# EasyEDA Pro project ZH_FLIGHT_H7B0.eprj, schematic Schematic1 (continued)
## Sheets (continued)
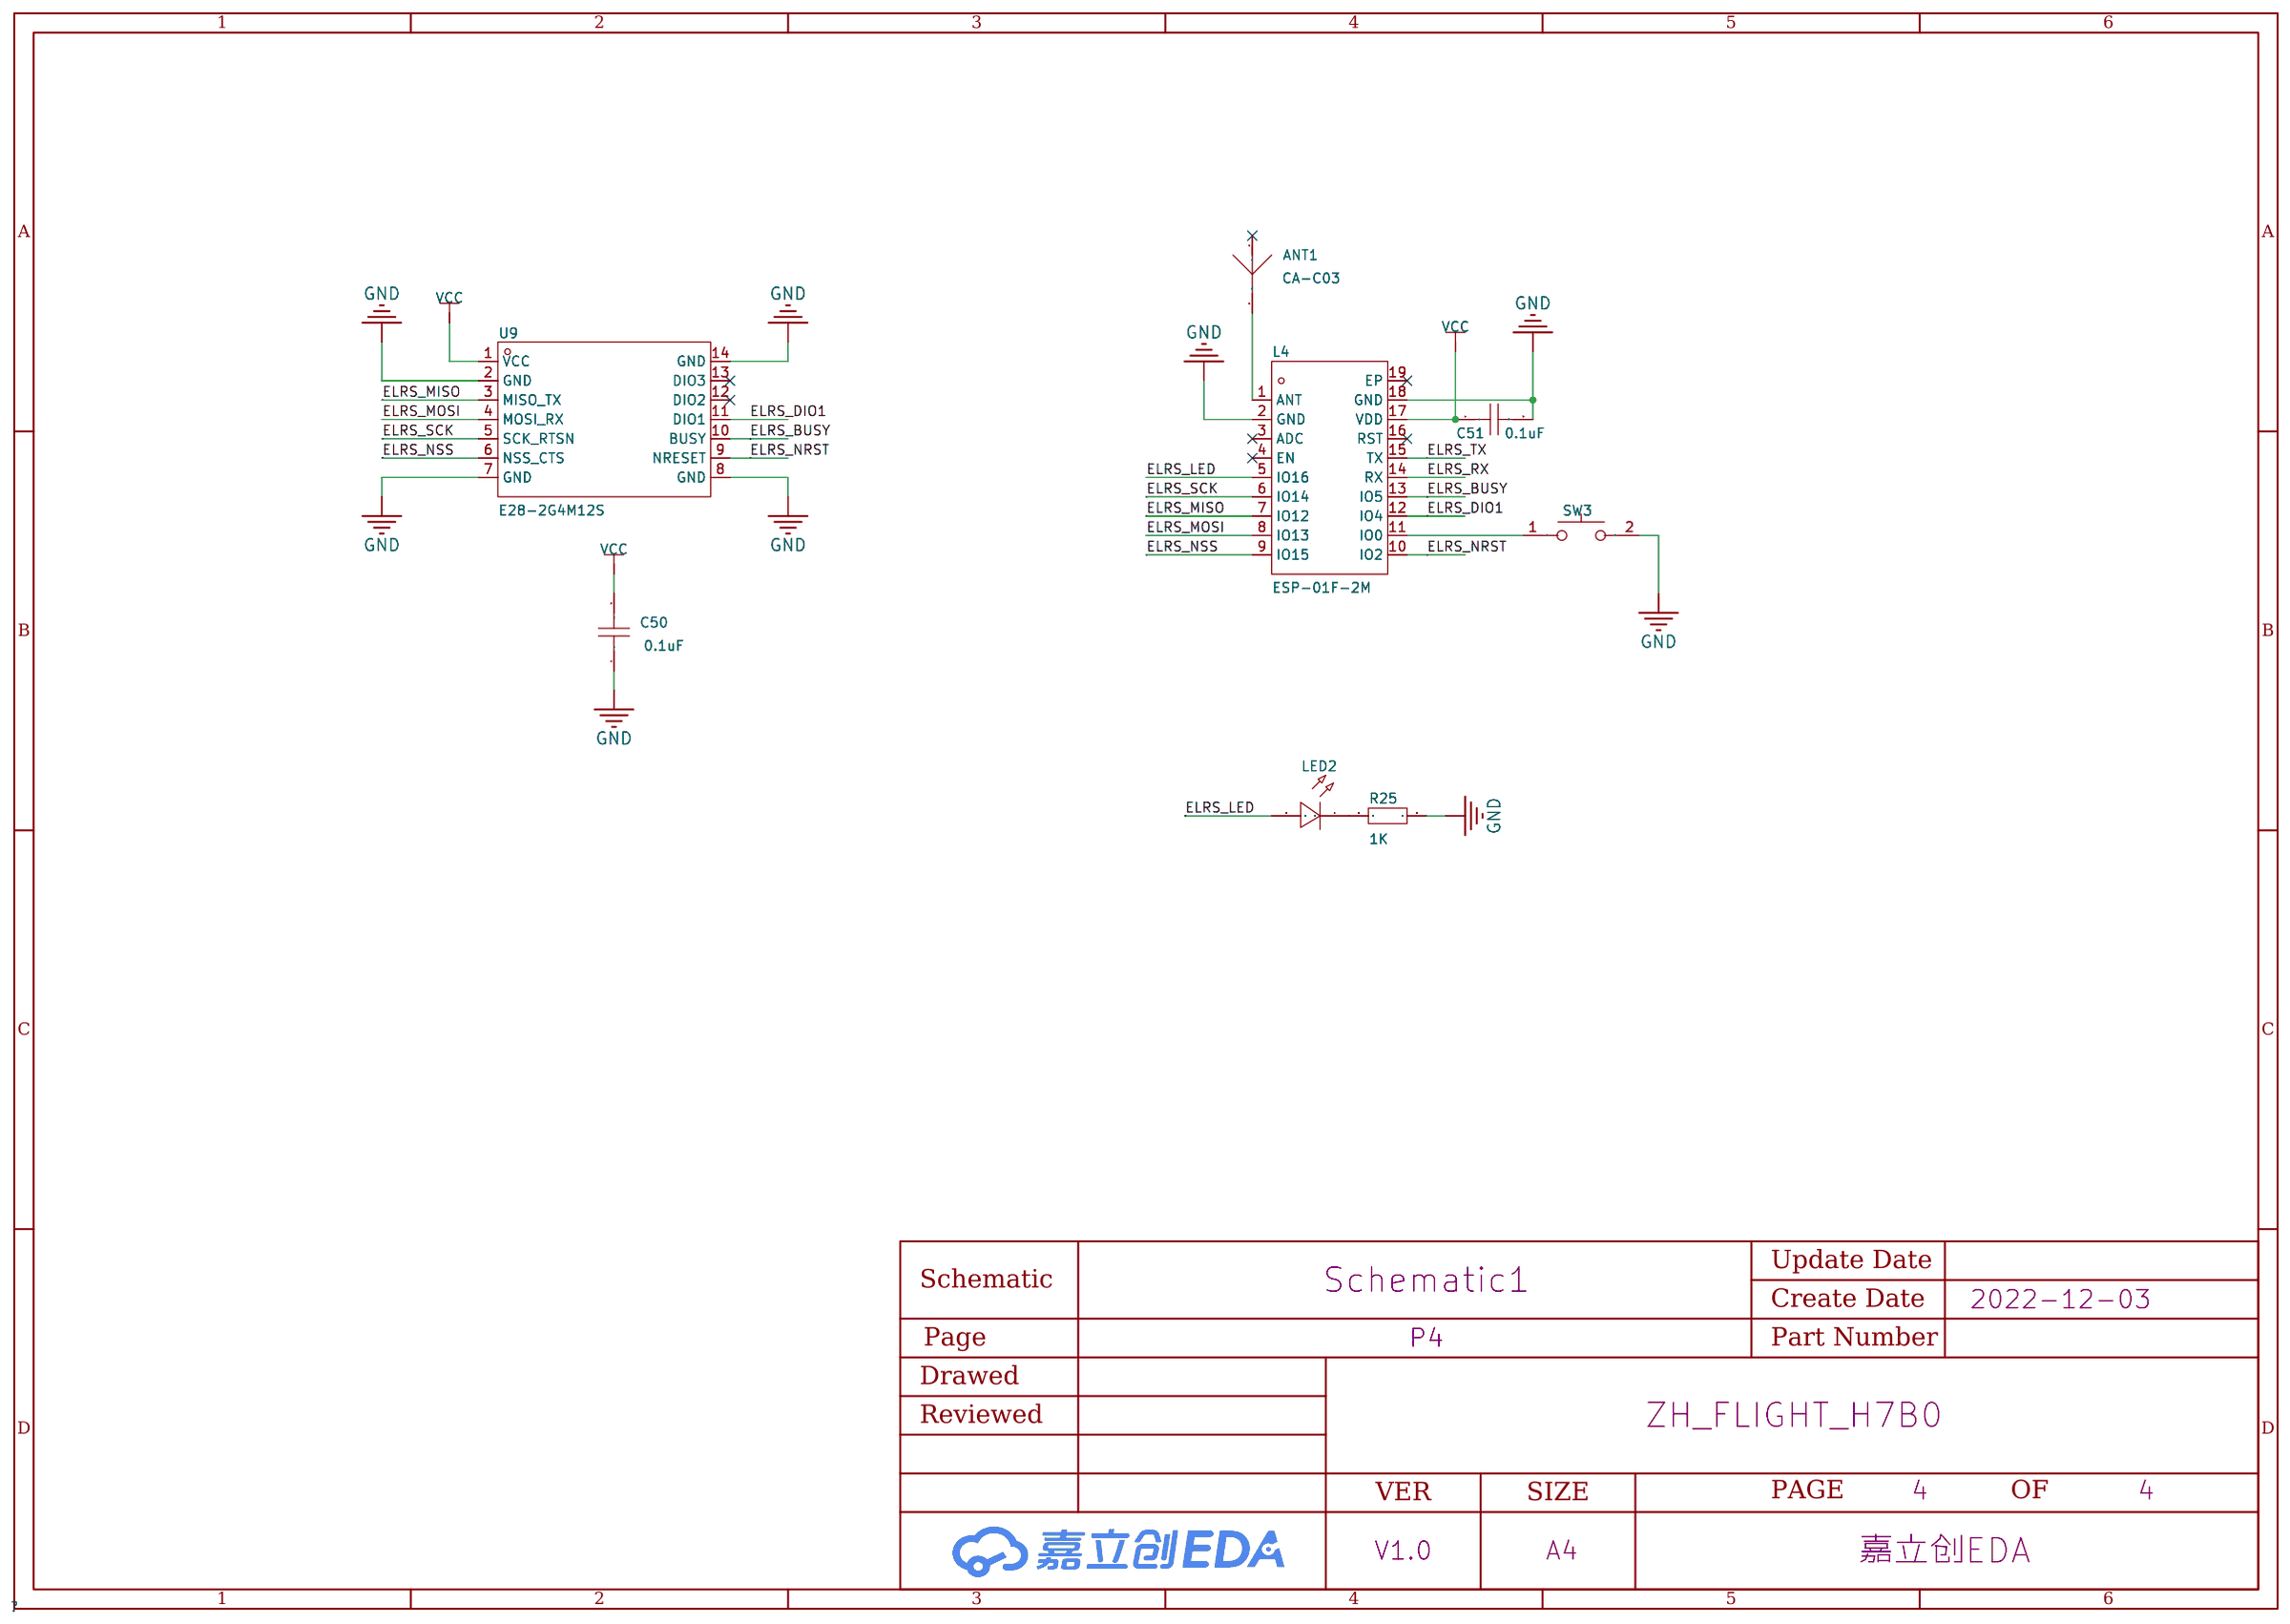
[diagram p3: P4]

## Parts
sheet P1
C1  2.2uF  [C0402]
C2  2.2uF  [C0402]
C3  22pF  [C0402]
C4  22pF  [C0402]
C5  6pF  [C0402]
C6  6pF  [C0402]
C7  0.1uF  [C0402]
C8  0.1uF  [C0402]
C9  0.1uF  [C0402]
C10  0.1uF  [C0402]
C11  0.1uF  [C0402]
C12  10uF  [C0402]
C13  10uF  [C0402]
C14  10uF  [C0402]
C15  10uF  [C0402]
C16  0.1uF  [C0402]
C17  0.1uF  [C0402]
C18  0.1uF  [C0402]
C19  0.1uF  [C0402]
C20  10uF  [C0402]
C21  22pF  [C0402]
C22  10uF  [C0402]
C23  0.1uF  [C0402]
CN1  GH1.25-2PWBPZ  [CONN-SMD_GH1.25-2PWBPZ]
CN2  GH1.25-2PWBPZ  [CONN-SMD_GH1.25-2PWBPZ]
CN3  GH1.25-2PWBPZ  [CONN-SMD_GH1.25-2PWBPZ]
CN4  GH1.25-2PWBPZ  [CONN-SMD_GH1.25-2PWBPZ]
CN5  GH1.25-2PWBPZ  [CONN-SMD_GH1.25-2PWBPZ]
CN6  GH1.25-2PWBPZ  [CONN-SMD_GH1.25-2PWBPZ]
CN7  GH1.25-2PWBPZ  [CONN-SMD_GH1.25-2PWBPZ]
CN8  HDGC2001WR-S-2P  [CONN-SMD_2P-P2.00_HDGC_HDGC2001WR-S-2P]
CN9  HDGC2001WR-S-2P  [CONN-SMD_2P-P2.00_HDGC_HDGC2001WR-S-2P]
D1  BAT54C-KL3  [sot-23-3_l2.9-w1.3-p1.90-ls2.4-br]
D2  1N4148WS  [sod-323_l1.8-w1.3-ls2.5-rd]
E1  CESD5V0D3 ZA  [sod-323_l1.8-w1.3-ls2.5-rd]
E2  CESD3V3D3 YU  [sod-323_l1.8-w1.3-ls2.5-rd]
L1  SCBG160808U501T  [l0603]
L2  2.2uH  [ind-smd_l2.5-w2.0]
LED1  -  [LED0603-RD_BLUE]
LED3  -  [LED0603-RD_BLUE]
LED4  -  [LED0603-RD]
OS1  25MHz  [osc-smd_4p-l3.2-w2.5-bl]
OS2  32.768kHz  [osc-smd_2p-l1.6-w1.0]
Q1  SS8050  [sot-23-3_l2.9-w1.3-p1.90-ls2.4-br]
Q2  SS8050  [sot-23-3_l2.9-w1.3-p1.90-ls2.4-br]
R1  0R  [R0402]
R2  10K  [R0402]
R3  10K  [R0402]
R4  10K  [R0402]
R5  1K  [R0402]
R6  10K  [R0402]
R7  680K  [R0402]
R8  150K  [R0402]
R9  5.1K  [R0402]
R10  5.1K  [R0402]
R12  10K  [R0402]
R13  10K  [R0402]
R14  10K  [R0402]
R15  10K  [R0402]
R16  3K  [R0402]
R28  1K  [R0402]
SW1  K2-1827SQ-C3DW-06  [sw-smd_l3.0-w2.0-ls3.5]
SW2  K2-1827SQ-C3DW-06  [sw-smd_l3.0-w2.0-ls3.5]
U1  STM32H7B0VBT6  [lqfp-100_l14.0-w14.0-p0.50-ls16.0-bl]
U2  XT3410AFMR-G  [sot-23-5_l3.0-w1.7-p0.95-ls2.8-bl]
U8  W25Q64JVXGIQ  [XSON-8_L4.0-W4.0-P0.80-TL-EP]
U10  GH1.25-4PLTPZ  [CONN-SMD_4P-P1.25_GH1.25-4P]
U11  GH1.25-4PLTPZ  [CONN-SMD_4P-P1.25_GH1.25-4P]
U12  GH1.25-4PLTPZ  [CONN-SMD_4P-P1.25_GH1.25-4P]
U13  GH1.25-4PLTPZ  [CONN-SMD_4P-P1.25_GH1.25-4P]
USB1  TYPEC-304A-ACP16W  [usb-c_smd-type-c-31-m-12]
sheet P2
C24  0.1uF  [C0402]
C25  2.2uF  [C0402]
C26  0.47uF  [C0402]
C27  10nF  [C0402]
C28  0.1uF  [C0402]
C29  0.22uF  [C0402]
C30  4.7uF  [C0402]
C31  0.1uF  [C0402]
C52  10nF  [C0402]
C53  0.1uF  [C0402]
C54  2.2uF  [C0402]
R11  ICM-20689  [QFN-24_L4.0-W4.0-P0.50-TL-EP2.6]
R26  ICM-42688-P  [LGA-14_L3.0-W2.5-P0.50-TL]
R27  10K  [R0402]
U4  MS5611-01BA03  [SENSORS-SMD_MS5611-01BA03]
U5  QMC5883L  [LGA-16_L3.0-W3.0-P0.50-BL_SQ]
sheet P3
C41  N/A  [C1206]
C42  22uF  [C1206]
C43  0.1uF  [C0402]
C44  0.1uF  [C0402]
C45  0.1uF  [C0402]
C46  33pF  [C0402]
C47  22uF  [C0805]
C48  22uF  [C0805]
C49  N/A  [C0805]
L3  4.7uH  [IND-SMD_L7.3-W6.6]
R19  100K  [R0402]
R20  10R  [R0402]
R21  0R  [R0402]
R22  40.2K  [R0402]
R23  5.49K  [R0402]
U6  MP2225GJ  [TSOT-23-8_L2.9-W1.6-P0.65-LS2.8-BR]
U7  SMAJ12A  [SMA_L4.3-W2.6-LS5.2-RD]
sheet P4
ANT1  CA-C03  [ANT-SMD_CA-C03]
C50  0.1uF  [C0402]
C51  0.1uF  [C0402]
L4  ESP-01F-2M  [wifim-smd_esp-01f-2m]
LED2  -  [LED0603-RD]
R25  1K  [R0402]
SW3  K2-1827SQ-C3DW-06  [sw-smd_l3.0-w2.0-ls3.5]
U9  E28-2G4M12S  [WIRELM-SMD_E28-2G4M12S]

## Library data of the parts
C1-C31 C43-C46 C50-C54 = CAP_0402: Supplier Footprint: 0402
CN1-CN7 = GH1.25-2PWBPZ: LCSC Part Name: GH1.25-2P卧贴编带; Supplier Part: C2829251; Manufacturer: BOOMELE(博穆精密); JLCPCB Part Class: 扩展库; Datasheet: https://atta.szlcsc.com/upload/public/pdf/source/20211125/08A09A4909F58AF780B71FE423A00F7E.pdf; Supplier: LCSC
CN8 CN9 = HDGC2001WR-S-2P: 参考系列:PH;间距:2mm;插针结构:1x2P;排数:1;每排PIN数:2;行距:-;公母:公型插针;安装方式:卧贴;额定电流:5A;工作温度范围:-25℃~+70℃;; LCSC Part Name: PH2.0针座卧贴 2P; Supplier Part: C2936224; Manufacturer: HDGC(华德共创); Supplier Footprint: SMD,P=2mm; JLCPCB Part Class: 扩展库; Datasheet: https://atta.szlcsc.com/upload/public/pdf/source/20211224/97C496F606ECD8881F21462B7EF9EC10.pdf; Supplier: LCSC; Reference Series: PH; Pitch: 2mm; Pins Structure: 1x2P; Number of Rows: 1; Number of PINs Per Row: 2; Gender: 公型插针; Mounting Style: 卧贴; Current Rating (Max): 5A; Operating Temperature Range: -25℃~+70℃
D1 = BAT54C-KL3: 二极管配置:1对共阴极;直流反向耐压(Vr):30V;平均整流电流(Io):200mA;正向压降(Vf):1V@100mA;反向电流(Ir):2A@25V;; LCSC Part Name: 30V 200mA 1V@100mA; Supplier Part: C779698; Manufacturer: ZRE(治润); Supplier Footprint: SOT-23; Datasheet: https://atta.szlcsc.com/upload/public/pdf/source/20201013/C779697_FADF87324DB075BDE4E981624DEB8F45.pdf; Supplier: LCSC; Diode Configuration: 1对共阴极; Reverse Voltage (Vr): 30V; Average Rectified Current (Io): 200mA; Forward Voltage (Vf@If): 1V@100mA; Reverse Leakage Current (Ir): 2A@25V
D2 = 1N4148WS_C2128: 二极管配置:独立式;功率:200mW;直流反向耐压(Vr):100V;平均整流电流(Io):150mA;正向压降(Vf):1.25V@150mA;反向电流(Ir):1A@75V;反向恢复时间(trr):4ns;工作温度:+150@(Tj);; LCSC Part Name: 100V 150mA 4ns T4; Supplier Part: C2128; Manufacturer: CJ（江苏长电/长晶）; Supplier Footprint: SOD-323; Datasheet: https://atta.szlcsc.com/upload/public/pdf/source/20140809/1457707208178.pdf; Supplier: LCSC; Diode Configuration: 独立式; Power Dissipation: 200mW; Reverse Voltage (Vr): 100V; Average Rectified Current (Io): 150mA; Forward Voltage (Vf@If): 1.25V@150mA; Reverse Leakage Current: 1A@75V; Reverse Recovery Time (trr): 4ns; Operating Temperature: +150@(Tj)
E1 = CESD5V0D3 ZA: 极性:Unidirectional;反向关断电压（典型值）:5V;击穿电压（最小值）:6.2V;箝位电压:15.5V;峰值脉冲电流（10/1000us）:15A;; LCSC Part Name: CESD5V0D3  ZA; Supplier Part: C22643; Manufacturer: CJ（江苏长电/长晶）; Supplier Footprint: SOD-323; Datasheet: https://atta.szlcsc.com/upload/public/pdf/source/20140301/1457707004115.pdf; Supplier: LCSC; Polarity: Unidirectional; Voltage - Reverse Standoff (Typ): 5V; Voltage - Breakdown (Min): 6.2V; Voltage - Clamping (Max) @ Ipp: 15.5V; Current - Peak Pulse (10/1000μs): 15A
E2 = CESD3V3D3 YU: 极性:Unidirectional;反向关断电压（典型值）:3.3V;击穿电压（最小值）:5V;箝位电压:13V;峰值脉冲电流（10/1000us）:16A;; Supplier Part: C38388; Manufacturer: CJ（江苏长电/长晶）; Supplier Footprint: SOD-323; Datasheet: https://atta.szlcsc.com/upload/public/pdf/source/20150915/1457707371129.pdf; Supplier: LCSC; Polarity: Unidirectional; Voltage - Reverse Standoff (Typ): 3.3V; Voltage - Breakdown (Min): 5V; Voltage - Clamping (Max) @ Ipp: 13V; Current - Peak Pulse (10/1000μs): 16A
L1 = SCBG160808U501T: 叠层片式通用磁珠0603 500±25% DCR0.6 额定电流150MA; LCSC Part Name: 500 ±25% @100MHz 150MA; Supplier Part: C480859; Manufacturer: Yanchuang(研创); Supplier Footprint: 0603; Datasheet: https://atta.szlcsc.comnull; Supplier: LCSC
L2 = WIP252010P-2R2ML: 电感值:2.2uH;精度:±20%;额定电流:2.3A;直流电阻(DCR):99m;; LCSC Part Name: 2.2uH ±20% 2.3A 99m; Supplier Part: C315713; Manufacturer: INPAQ(台湾佳邦); Supplier Footprint: SMD; Datasheet: https://atta.szlcsc.com/upload/public/pdf/source/20181022/C315713_B673B90C1AD4F1577F17AD7F983BB877.pdf; Supplier: LCSC; Tolerance: ±20%; Rated Current: 2.3A; DC Resistance (DCR): 99m
LED1 = LED_0603-R: 发光颜色:红灯;二极管配置:-;透镜颜色:无色透明;主波长:617.5nm;峰值波长:632nm;色温:-;光通量(25℃时):-;测试电流:5mA;正向电压(VF):2.2V;发光强度:28.5mcd;功率:60mW;发光角度:120°;安装方式:-;工作温度:-40℃~+85℃;; Supplier Footprint: 0603; Supplier Part: C72044
LED3 = LED_0603-B: 照明颜色:蓝色;主波长/色坐标:465~475nm;; Supplier Footprint: 0603; Supplier Part: C72041
LED2 LED4 = LED_0603-G: 照明颜色:翠绿;色温 - CCT（K）:-;主波长/色坐标:520~535nm;; Supplier Footprint: 0603; Supplier Part: C72043
OS1 = X322525MOB4SI: 晶振类型:贴片无源晶振;频率:25MHz;频率公差:±10ppm;频率稳定度:±30ppm;负载电容:12pF;工作温度:-40~+85;; LCSC Part Name: 25MHz ±10ppm 12pF; Supplier Part: C9006; Manufacturer: YXC(扬兴晶振); Supplier Footprint: SMD3225-4P; Datasheet: https://atta.szlcsc.com/upload/public/pdf/source/20210329/C112971_1F611BDC486E193C1706F6D8EB5AA189.pdf; Supplier: LCSC; Crystal Type: 贴片无源晶振; Frequency Tolerance: ±10ppm; Frequency Stability: ±30ppm; Load Capacitance: 12pF; Operating Temperature: -40~+85
OS2 = X1A0001210005: 晶振类型:贴片无源晶振;频率:32.768kHz;频率公差:±20ppm;负载电容:12.5pF;工作温度:-40~+85;; LCSC Part Name: 32.768kHz ±20ppm 12.5pF; Supplier Part: C165064; Manufacturer: EPSON(爱普生); Supplier Footprint: SMD1610-2P; Datasheet: https://atta.szlcsc.com/upload/public/pdf/source/20181223/C165064_89E145695707DA426F5051ABEBF35627.pdf; Supplier: LCSC; Crystal Type: 贴片无源晶振; Frequency Tolerance: ±20ppm; Load Capacitance: 12.5pF; Operating Temperature: -40~+85
Q1 Q2 = SS8050_C2150: 晶体管类型:NPN;集射极击穿电压(Vceo):25V;集电极电流(Ic):1.5A;功率(Pd):300mW;集电极-发射极饱和电压(VCE(sat)@Ic,Ib):500mV@800mA,80mA;直流电流增益(hFE@Ic,Vce):200@100mA,1V;特征频率(fT):100MHz;工作温度:+150@(Tj);; LCSC Part Name: SS8050 Y1 200-350 Y1 200-350; Supplier Part: C2150; Manufacturer: CJ(江苏长电/长晶); Supplier Footprint: SOT-23(SOT-23-3); Datasheet: https://atta.szlcsc.com/upload/public/pdf/source/20140809/1457707209319.pdf; Supplier: LCSC; Transistor Type: NPN; Collector-Emitter Breakdown Voltage (Vceo): 25V; Collector Current (Ic): 1.5A; Power Dissipation (Pd): 300mW; Collector-Emitter Saturation Voltage (VCE(sat)@Ic,Ib): 500mV@800mA,80mA; DC Current Gain (hFE@Ic,Vce): 200@100mA,1V; Transition Frequency (fT): 100MHz; Operating Temperature: +150@(Tj)
R1-R10 R12-R16 R19-R23 R25 R27 R28 = Res_0402: Supplier Footprint: 0402
SW1-SW3 = K2-1827SQ-C3DW-06: 触点电流:50mA;额定电压(DC):12V;绝缘电阻:100M;电路结构:单刀单掷;安装方式:立贴;按钮形状:圆形按钮;带灯:-;作用力:180gf@±30gf;机械寿命:100000;工作温度:-25~+85;开关长度:3mm;开关宽度:2mm;开关高度:0.65mm;; LCSC Part Name: 薄膜开关 3.0mm*2.0mm*0.65mm 180G; Supplier Part: C128936; Manufacturer: 韩国韩荣; Supplier Footprint: SMD; Datasheet: https://atta.szlcsc.com/upload/public/pdf/source/20210810/197683357D425767B80DA50394975E40.pdf; Supplier: LCSC; Contact Current: 50mA; Voltage Rating (DC): 12V; Insulation Resistance: 100M; Circuit: 单刀单掷; Mounting Style: 立贴; Actuator Style: 圆形按钮; Operating Force: 180gf@±30gf; Mechanical Life: 100000; Operating Temperature: -25~+85; Switch Length: 3mm; Switch Width: 2mm; Switch Height: 0.65mm
U1 = STM32H7B0VBT6: CPU位数:-;ROM类型:-;CPU内核:-;主频（MAX):-;工作电压:-;; Supplier Part: C730227; Manufacturer: ST(意法半导体); Supplier Footprint: LQFP-100; Datasheet: https://atta.szlcsc.com/upload/public/pdf/source/20200902/C730225_664883C886B4E760FDC927233147DBDC.pdf; Supplier: LCSC
U2 = XT3410AFMR-G: 功能类型:降压型;同步整流:-;输出通道数:-;拓扑结构:-;输入电压:-;输出电流(最大值):-;开关频率:-;; LCSC Part Name: 降压型; Supplier Part: C190829; Manufacturer: natlinear(南麟); Supplier Footprint: SOT-23-5L; Datasheet: https://atta.szlcsc.com/upload/public/pdf/source/20180417/C190829_F6912E3BE098993FBE8C3B1025739217.pdf; Supplier: LCSC; Function: 降压型
U8 = W25Q64JVXGIQ: Supplier Part: C2940195; Manufacturer: WINBOND(华邦); Supplier Footprint: XSON-8(4x4); JLCPCB Part Class: 扩展库; Datasheet: https://atta.szlcsc.com/upload/public/pdf/source/20220111/96C134BA110DAC08742B3CB6C4519B4C.pdf; Supplier: LCSC
U10-U13 = GH1.25-4PLTPZ: LCSC Part Name: GH1.25-4P立贴编带加盖; Supplier Part: C2829262; Manufacturer: BOOMELE(博穆精密); JLCPCB Part Class: 扩展库; Datasheet: https://atta.szlcsc.com/upload/public/pdf/source/20211125/08A09A4909F58AF780B71FE423A00F7E.pdf; Supplier: LCSC
USB1 = TYPEC-304A-ACP16W: 连接器类型:Type-C;标准:USB 3.1;公母:母座;触点数量:16;端口数量:1;安装方式:卧贴;额定电流 - 电源:5A;工作温度范围:-45~+85;焊接温度(最大值):260;; LCSC Part Name: Type-C 母座 卧贴; Supplier Part: C2909607; Manufacturer: XUNPU(讯普); Supplier Footprint: SMD,8.94x7.35x3.26mm; Datasheet: https://atta.szlcsc.com/upload/public/pdf/source/20211029/5A76838C591B377E5BF09726BF37DE5A.pdf; Supplier: LCSC; Connector Type: Type-C; Standard: USB 3.1; Gender: 母座; Number of Contacts: 16; Number of Ports: 1; Mounting Style: 卧贴; Current Rating - Power (Max): 5A; Operating Temperature Range: -45~+85; Welding Temperature (Max): 260
R11 = ICM-20689: Supplier Part: C2649494; Manufacturer: TDK InvenSense(应美盛); Supplier Footprint: QFN-24(4x4); JLCPCB Part Class: 扩展库; Datasheet: https://atta.szlcsc.com/upload/public/pdf/source/20210612/84049ED953CCDAE32DEC78FBBA9615C4.pdf; Supplier: LCSC
R26 = ICM-42688-P: LCSC Part Name: ICM 42688 P; Supplier Part: C1850418; Manufacturer: TDK InvenSense(应美盛); JLCPCB Part Class: 扩展库; Datasheet: https://atta.szlcsc.com/upload/public/pdf/source/20210703/CF24204867ACE5B754A2B035F23E5931.pdf; Supplier: LCSC
U4 = MS5611-01BA03: 类型:-;波长:-;近距离探测:-;输出类型:-;; Supplier Part: C37148; Manufacturer: MEAS; Supplier Footprint: QFN-8(5x3); JLCPCB Part Class: 扩展库; Datasheet: https://atta.szlcsc.com/upload/public/pdf/source/20140924/1457707242210.pdf; Supplier: LCSC
U5 = QMC5883L: LCSC Part Name: 三轴磁传感器; Supplier Part: C976032; Manufacturer: QST(上海矽睿); Supplier Footprint: LGA-16(3x3x0.9mm); JLCPCB Part Class: 扩展库; Datasheet: https://atta.szlcsc.com/upload/public/pdf/source/20201217/C976032_5B9A2F3901E175046CBA037B1F18A1F2.pdf; Supplier: LCSC
C41 C42 = CAP_1206: Supplier Footprint: 1206
C47-C49 = CAP_0805: Supplier Footprint: 0805
L3 = MCS0630-4R7MPY1: 电感值:4.7uH;精度:±20%;额定电流:5.5A;饱和电流(Isat):7A;直流电阻(DCR):37mΩ;; LCSC Part Name: 4.7uH ±20% 5.5A 37mΩ; Supplier Part: C2937097; Manufacturer: PSA(信昌电陶); Supplier Footprint: 0630; JLCPCB Part Class: 扩展库; Datasheet: https://atta.szlcsc.com/upload/public/pdf/source/20220121/EA6E6E6F70ED7BAE67EC293805EAAACB.pdf; Supplier: LCSC; Tolerance: ±20%; Rated Current: 5.5A; Saturation Current (Isat): 7A; DC Resistance (DCR): 37mΩ
U6 = MP2225GJ: link: https://www.monolithicpower.com/en/documentview/productdocument/index/version/2/document_type/Datasheet/lang/en/sku/MP2225GJ-Z/document_id/922/
U7 = SMAJ12A_C2991109: 极性:单向;反向截止电压(Vrwm):12V;击穿电压(最小值):13.3V;击穿电压(最大值):15.3V;反向漏电流(Ir):5uA;峰值脉冲电流(Ipp)@10/1000s:20.1A;最大钳位电压:19.9V;; LCSC Part Name: 单向 Vrwm:12V; Supplier Part: C2991109; Manufacturer: SUNMATE(森美特); Supplier Footprint: SMA/DO-214AC; JLCPCB Part Class: 扩展库; Datasheet: https://atta.szlcsc.com/upload/public/pdf/source/20220427/B75BE6AB9B7C97585C60DE27DE4A19A3.pdf; Supplier: LCSC; Polarity: 单向; Reverse Stand-Off Voltage (Vrwm): 12V; Breakdown Voltage (Min): 13.3V; Breakdown Voltage (Max): 15.3V; Reverse Leakage Current (Ir): 5uA; Peak Pulse Current (Ipp)@10/1000μs: 20.1A; Maximum Clamping Voltage: 19.9V
ANT1 = CA-C03: Supplier Part: C2838842; Supplier Footprint: 5520; JLCPCB Part Class: 扩展库; Datasheet: 2021-06-05/34112A/eaa7f794ae26492fadde70fdd3fe967f/CA-C03应用手册.pdf; Supplier: LCSC
L4 = ESP-01F-2M: LCSC Part Name: WIFI模块 ESP-01F-2M版; Supplier Part: C2764054; Manufacturer: Ai-Thinker(安信可); Datasheet: https://atta.szlcsc.com/upload/public/pdf/source/20210401/C2764054_7A91A27C6594F8A1968F9CAA7474E658.pdf; Supplier: LCSC
U9 = E28-2G4M12S: SX1280无线模块(SX1278的2.4GHz版)无线测距/定位LoRa扩频2.4G; Supplier Part: C411310; Manufacturer: EBYTE(亿佰特); Supplier Footprint: SMD,14.0x25.0mm; JLCPCB Part Class: 扩展库; Datasheet: https://atta.szlcsc.com/upload/public/pdf/source/20190812/C411310_35CC255654AEA531A1D9F26CF905C5EF.pdf; Supplier: LCSC

## Nets
+5V: C20.2 C46.2 C47.2 C48.2 C49.2 CN9.1 E1.1 L3.2 R22.2 U2.1(CE) U2.4(VIN) USB1.A4(VBUS) USB1.A9(VBUS) USB1.B4(VBUS) USB1.B9(VBUS)
+12V: C41.2 C42.2 C43.2 CN8.1 R19.1 U6.2(IN) U7.2
GND: C1.2 C2.1 C3.1 C4.1 C5.1 C6.1 C7.1 C8.1 C9.1 C10.1 C11.1 C12.1 C13.1 C14.1 C15.1 C16.1 C17.1 C18.1 C19.1 C20.1 C22.1 C23.1 C24.1 C25.1 C26.1 C27.1 C28.1 C30.2 C31.1 C41.1 C42.1 C43.1 C44.1 C47.1 C48.1 C49.1 C50.1 C51.2 C52.1 C53.1 C54.1 CN1.3 CN1.4 CN2.3 CN2.4 CN3.3 CN3.4 CN4.3 CN4.4 CN5.3 CN5.4 CN6.3 CN6.4 CN7.3 CN7.4 CN8.2 CN8.3 CN8.4 CN9.2 CN9.3 CN9.4 E1.2 E2.2 L4.2(GND) L4.18(GND) LED1.1(C) LED4.1(C) Q1.2(E) R3.1 R6.1 R8.1 R9.2 R10.1 R11.11(FSYNC) R11.18(GND) R23.1 R25.2 R26.6(GND) R26.11(RESV) R27.2 SW2.2 SW3.2 U1.10(VSS) U1.19(VSSA) U1.26(VSS) U1.49(VSS) U1.74(VSS) U1.99(VSS) U2.2(GND) U4.3(GND) U4.4(CSB) U4.5(CSB) U5.9(GND) U5.11(GND) U6.1(AGND) U6.4(GND) U7.1 U8.4(GND) U9.2(GND) U9.7(GND) U9.8(GND) U9.14(GND) U10.5 U10.6 U11.5 U11.6 U12.5 U12.6 U13.5 U13.6 USB1.0(EH) USB1.1(EH) USB1.2(EH) USB1.3(EH) USB1.A1(GND) USB1.A12(GND) USB1.B1(GND) USB1.B12(GND)
VBAT: C16.2 D1.3(K) U1.6(VBAT)
VBAT_EXT: D1.2(A)
VCC: C7.2 C8.2 C9.2 C10.2 C11.2 C21.2 C22.2 C23.2 C24.2 C25.2 C27.2 C28.2 C31.2 C50.2 C51.1 C52.2 C53.2 C54.2 D1.1(A) E2.1 L1.1 L2.2 L4.17(VDD) R4.2 R5.2 R7.2 R11.8(VDDIO) R11.13(VDD) R12.1 R13.1 R14.1 R15.1 R16.1 R26.5(VDDIO) R26.8(VDD) R28.1 SW1.1 U1.11(VDD) U1.27(VDD) U1.50(VDD) U1.75(VDD) U1.100(VDD) U4.1(VDD) U4.2(PS) U5.2(VDD) U5.4(S1) U5.13(VDDIO) U8.8(VCC) U9.1(VCC)
VDDA: C12.2 C13.2 L1.2 R1.2 U1.21(VDDA)
25M_IN: C3.2 OS1.3(OSC2) U1.12(PH0-OSC_IN)
25M_OUT: C4.2 OS1.1(OSC1) U1.13(PH1-OSC_OUT)
32K_IN: C5.2 OS2.2(OSC2) U1.8(PC14-OSC32_ON)
32K_OUT: C6.2 OS2.1(OSC1) U1.9(PC15-OSC32_OUT)
ADC1_10: U1.15(PC0) U13.3
ADC1_11: U1.16(PC1) U13.4
ADC2_8: U1.33(PC5) U13.1
ADC2_9: U1.34(PB0) U13.2
BOOT0: LED1.2(A) Q2.2(E) R6.2 U1.94(BOOT0)
ELRS_BUSY: L4.13(IO5) U9.10(BUSY)
ELRS_DIO1: L4.12(IO4) U9.11(DIO1)
ELRS_LED: L4.5(IO16) LED2.2(A)
ELRS_MISO: L4.7(IO12) U9.3(MISO_TX)
ELRS_MOSI: L4.8(IO13) U9.4(MOSI_RX)
ELRS_NRST: L4.10(IO2) U9.9(NRESET)
ELRS_NSS: L4.9(IO15) U9.6(NSS_CTS)
ELRS_RX: L4.14(RX) U1.86(PD5)
ELRS_SCK: L4.6(IO14) U9.5(SCK_RTSN)
ELRS_TX: L4.15(TX) U1.87(PD6)
EXTI3: CN7.1 U1.89(PB3)
EXTI7: CN7.2 U1.88(PD7)
IIC1_EXIT: U1.97(PE0) U5.15(DRDY)
IIC1_SCL: R14.2 U1.95(PB8) U4.8(SCLK) U5.1(SCL)
IIC1_SDA: R15.2 U1.96(PB9) U4.7(SDI/SDA) U5.16(SDA)
IIC2_SCL: CN5.2 R12.2 U1.46(PB10)
IIC2_SDA: CN5.1 R13.2 U1.47(PB11)
IMU1_CLK: R11.23(SCL/SCLK) U1.29(PA5)
IMU1_CS: R11.22(nCS) U1.28(PA4)
IMU1_EXIT: R11.12(INT) U1.32(PC4)
IMU1_MISO: R11.9(AD0/SDO) U1.30(PA6)
IMU1_MOSI: R11.24(SDA/SDI) U1.31(PA7)
IMU2_CLK: R26.13(AP_SCL/AP_SCLK) U1.78(PC10)
IMU2_CS: R26.12(AP_CS) U1.81(PD0)
IMU2_EXIT: R26.4(INT1/INT) U1.77(PA15)
IMU2_MISO: R26.1(AP_SDO/AP_AD0) U1.79(PC11)
IMU2_MOSI: R26.14(AP_SDA/AP_SDIO/AP_SDI) U1.80(PC12)
LED: LED3.1(C) U1.18(PC3_C)
PWM1: U1.63(PC6) U10.1
PWM2: U1.64(PC7) U10.2
PWM3: U1.65(PC8) U10.3
PWM4: U1.66(PC9) U10.4
PWM5: U1.22(PA0) U11.1
PWM6: U1.23(PA1) U11.2
PWM7: U1.24(PA2) U11.3
PWM8: U1.25(PA3) U11.4
PWM9: U1.62(PD15) U12.1
PWM10: U1.61(PD14) U12.2
PWM11: U1.91(PB5) U12.3
PWM12: U1.90(PB4) U12.4
QSPI_BK1_IO0: U1.58(PD11) U8.5(DI(IO0))
QSPI_BK1_IO1: U1.59(PD12) U8.2(DO(IO1))
QSPI_BK1_IO2: U1.1(PE2) U8.3(IO2)
QSPI_BK1_IO3: U1.60(PD13) U8.7(IO3)
QSPI_BK1_NCS: U1.92(PB6) U8.1(CS#)
QSPI_CLK: U1.36(PB2) U8.6(CLK)
RST: C18.2 Q1.3(C) R4.1 SW2.1 U1.14(NRST)
SW_CLK: CN6.2 U1.76(PA14)
SW_DIO: CN6.1 U1.72(PA13)
UART1_RX: CN1.1 U1.54(PB15)
UART1_TX: CN1.2 U1.53(PB14)
UART3_RX: CN2.1 U1.56(PD9)
UART3_TX: CN2.2 U1.55(PD8)
UART5_RX: CN3.2 U1.51(PB12)
UART5_TX: CN3.1 U1.52(PB13)
UART7_RX: CN4.2 U1.37(PE7)
UART7_TX: CN4.1 U1.38(PE8)
USB_D+: U1.71(PA12) USB1.A6(DP1) USB1.B6(DP2)
USB_D-: U1.70(PA11) USB1.A7(DN1) USB1.B7(DN2)
VREF: C14.2 C15.2 R1.1 U1.20(VREF+)
$1N1678: C1.1 U1.73(VCAP)
$1N1681: C2.2 U1.48(VCAP)
$1N8061: C17.2 Q1.1(B) R2.2 R3.2
$1N8406: C19.2 D2.1(K) Q2.1(B)
$1N8466: Q2.3(C) R5.1
$1N9525: D2.2(A) R2.1 SW1.2
$1N12306: L2.1 U2.3(LX)
$1N12347: C21.1 R7.1 R8.2 U2.5(FB)
$1N18516: R9.1 USB1.A5(CC1)
$1N18565: R10.2 USB1.B5(CC2)
$1N50322: LED3.2(A) R28.2
$1N50898: LED4.2(A) R16.2
$2N794: C26.2 R11.10(REGOUT)
$2N2588: C29.2 U5.8(SETP)
$2N2599: C29.1 U5.12(SETC)
$2N2763: C30.1 U5.10(C1)
$2N4523: R26.9(INT2/FSYNC/CLKIN) R27.1
$3N1353: R19.2 U6.6(EN/SYNC)
$3N1354: C44.2 U6.7(VCC)
$3N1356: C45.2 L3.1 U6.3(SW)
$3N1361: R20.1 U6.5(BST)
$3N1362: C45.1 R20.2
$3N1363: C46.1 R21.2 R22.1 R23.2
$3N1365: R21.1 U6.8(FB)
$4N1181: L4.11(IO0) SW3.1
$4N1470: LED2.1(C) R25.1
$4N1612: ANT1.2(ANT) L4.1(ANT)

Not connected (* = marked no-connect by the designer): ANT1 1*; L4 3(ADC)* 4(EN)* 16(RST)* 19(EP)*; OS1 2(GND)* 4(GND)*; R11 1(NC)* 2(NC)* 3(NC)* 4(NC)* 5(NC)* 6(NC)* 7(NC)* 14(NC)* 15(NC)* 16(NC)* 17(NC)* 19(NC)* 20(NC)* 21(NC)* 25(EP)*; R26 2(RESV)* 3(RESV)* 7(RESV)* 10(RESV)*; U1 2(PE3)* 3(PE4)* 4(PE5)* 5(PE6)* 7(PC13)* 17(PC2_C)* 35(PB1)* 39(PE9)* 40(PE10)* 41(PE11)* 42(PE12)* 43(PE13)* 44(PE14)* 45(PE15)* 57(PD10)* 67(PA8)* 68(PA9)* 69(PA10)* 82(PD1)* 83(PD2)* 84(PD3)* 85(PD4)* 93(PB7)* 98(PE1)*; U4 6(SDO)*; U5 3(NC)* 5(NC)* 6(NC)* 7(NC)* 14(NC)*; U8 9(EP)*; U9 12(DIO2)* 13(DIO3)*; USB1 A8(SUB1)* B8(SUB2)*
